# EasyEDA Pro project 嵌入式.eprj, schematic Schematic4
Create Date: 2024-04-12; Page Name: P1; Project Name: 嵌入式; Schematic Name: Schematic4; Update Date: 2024-04-12; Company: 嘉立创EDA; Page Size: A4; Version: V1.0
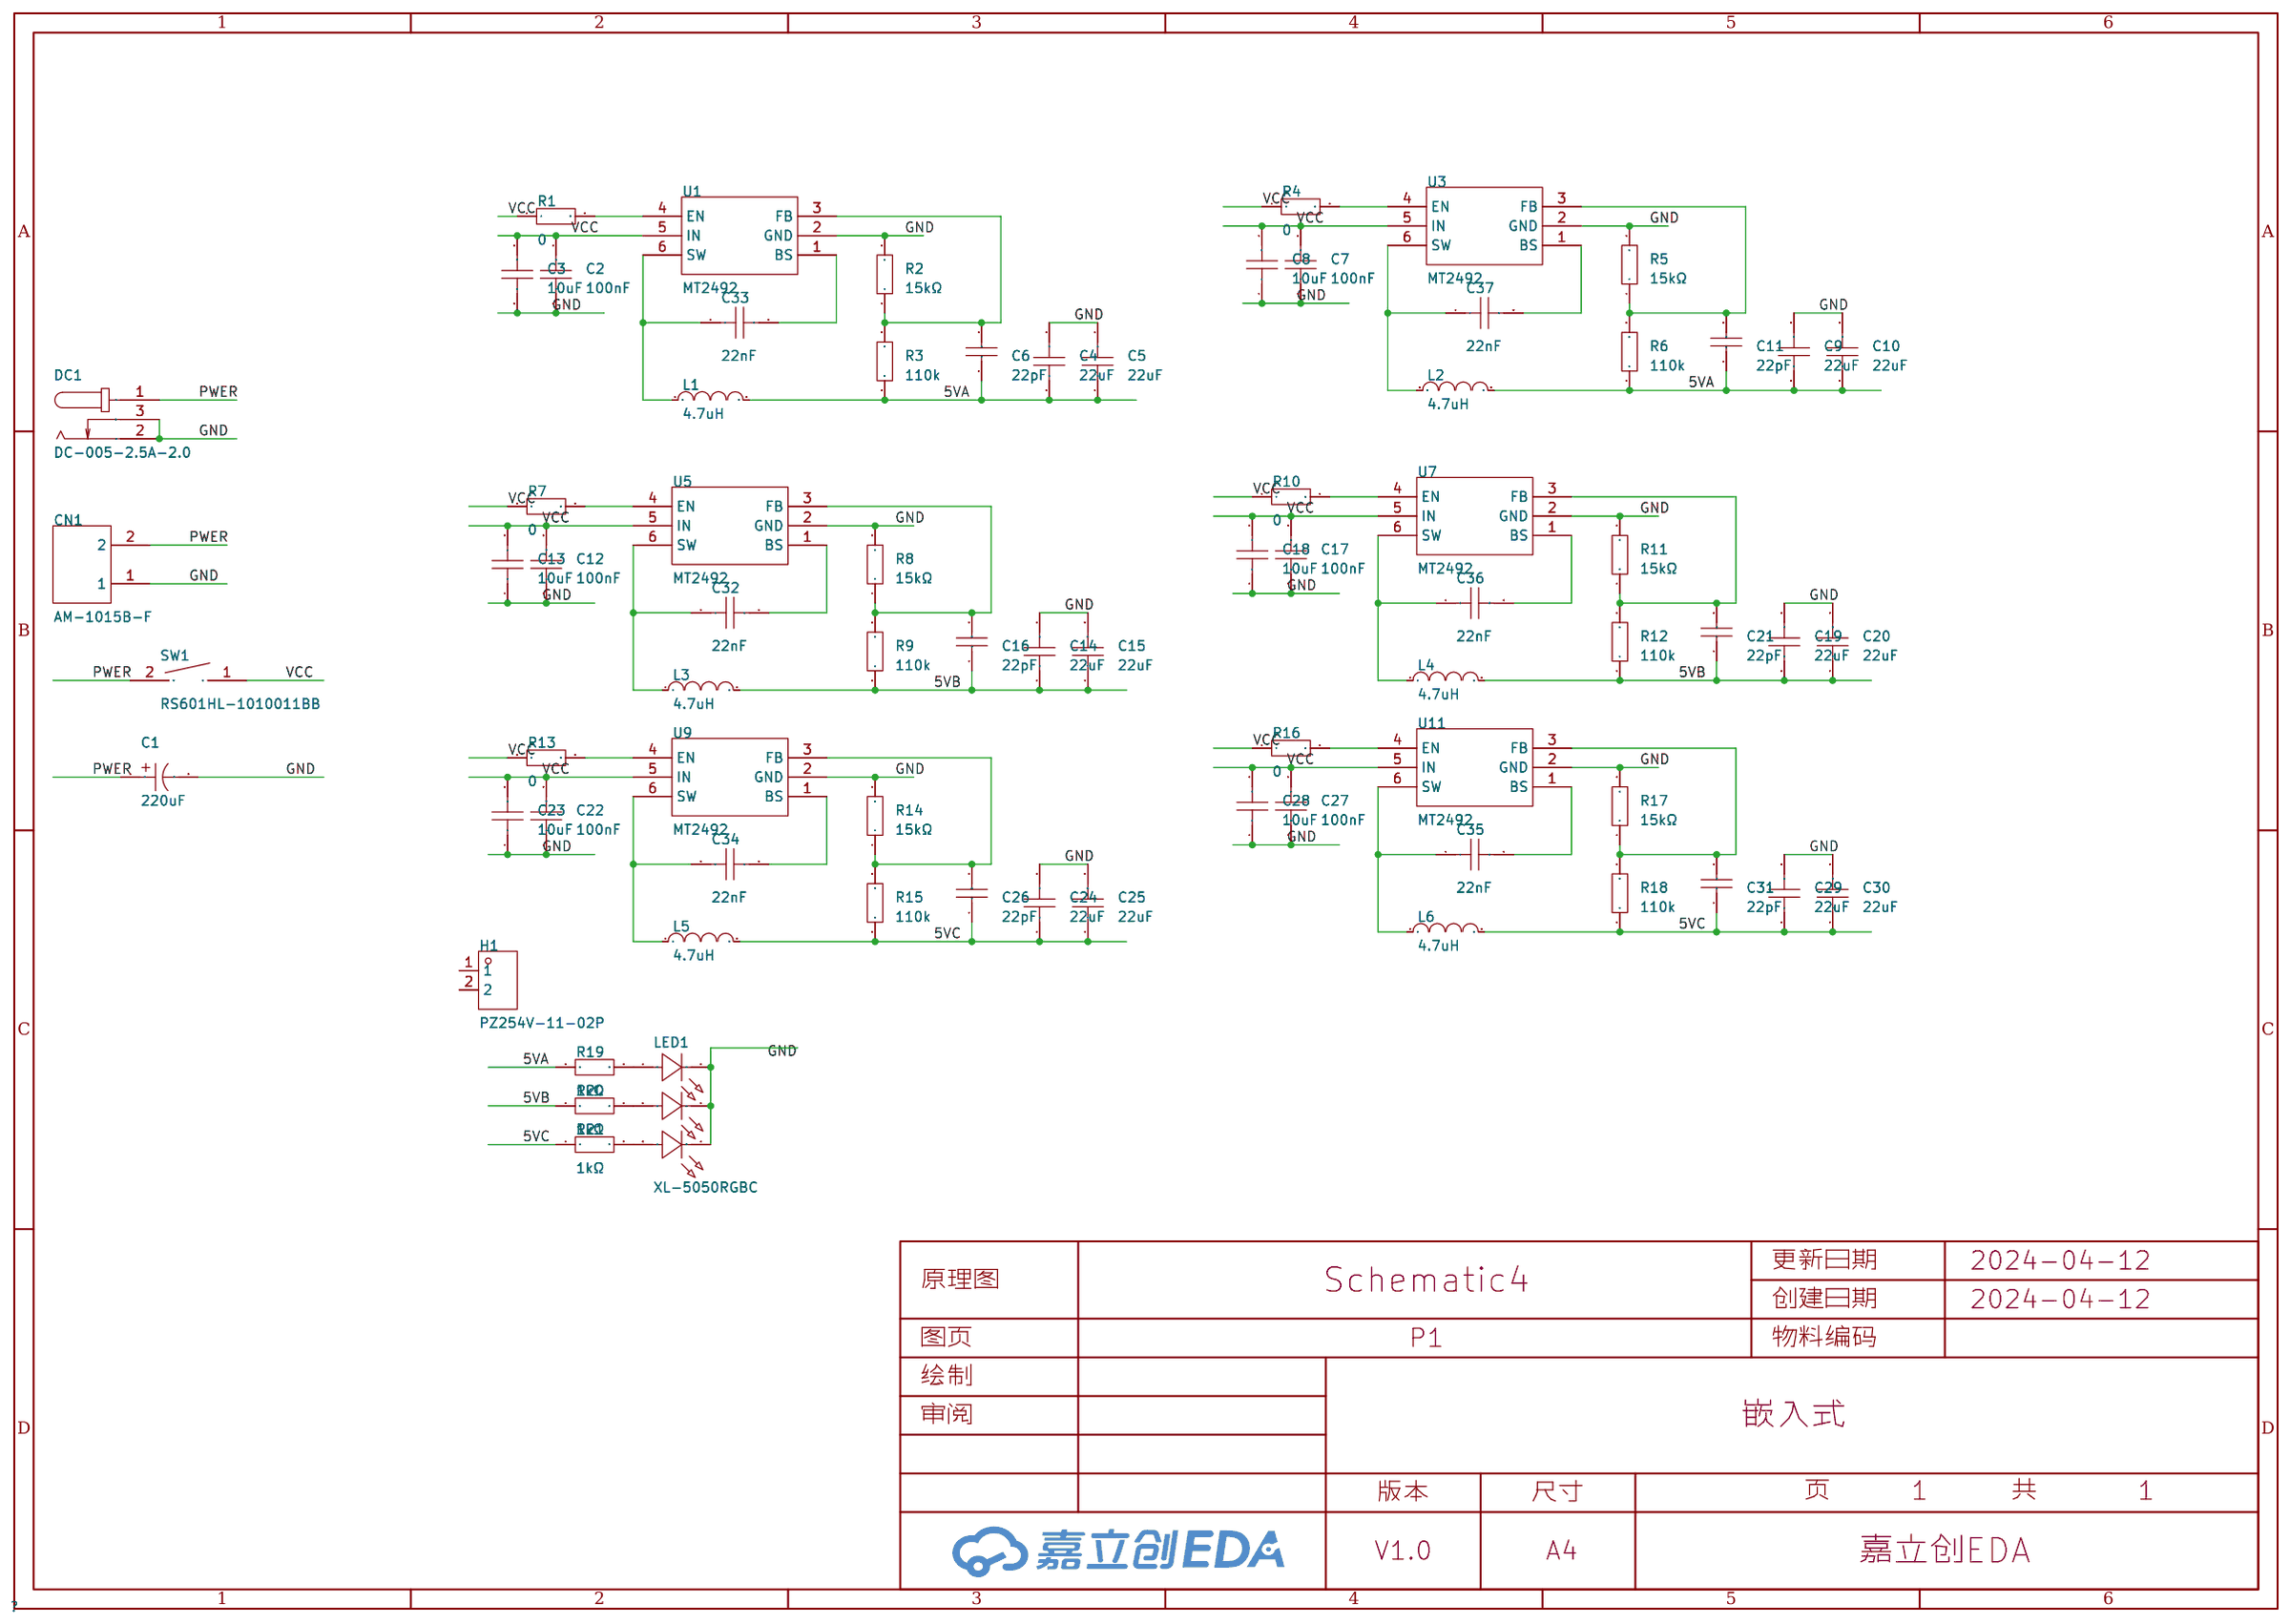
[diagram p3: schematic sheet]

## Parts
C1  220uF  [CAP-SMD_BD6.3-L6.6-W6.6-FD]
C2  100nF  [C0603]
C3  10uF  [C0805]
C4  22uF  [C0805]
C5  22uF  [C0805]
C6  22pF  [C0603]
C7  100nF  [C0603]
C8  10uF  [C0805]
C9  22uF  [C0805]
C10  22uF  [C0805]
C11  22pF  [C0603]
C12  100nF  [C0603]
C13  10uF  [C0805]
C14  22uF  [C0805]
C15  22uF  [C0805]
C16  22pF  [C0603]
C17  100nF  [C0603]
C18  10uF  [C0805]
C19  22uF  [C0805]
C20  22uF  [C0805]
C21  22pF  [C0603]
C22  100nF  [C0603]
C23  10uF  [C0805]
C24  22uF  [C0805]
C25  22uF  [C0805]
C26  22pF  [C0603]
C27  100nF  [C0603]
C28  10uF  [C0805]
C29  22uF  [C0805]
C30  22uF  [C0805]
C31  22pF  [C0603]
C32  22nF  [C0805]
C33  22nF  [C0805]
C34  22nF  [C0805]
C35  22nF  [C0805]
C36  22nF  [C0805]
C37  22nF  [C0805]
CN1  AM-1015B-F  [CONN-TH_AM-1015B-F]
DC1  DC-005-2.5A-2.0  [CONN-TH_DC-005-2.5A-2.0]
H1  PZ254V-11-02P  [HDR-TH_2P-P2.54-V-M]
L1  4.7uH  [IND-SMD_L4.4-W4.2]
L2  4.7uH  [IND-SMD_L4.4-W4.2]
L3  4.7uH  [IND-SMD_L4.4-W4.2]
L4  4.7uH  [IND-SMD_L4.4-W4.2]
L5  4.7uH  [IND-SMD_L4.4-W4.2]
L6  4.7uH  [IND-SMD_L4.4-W4.2]
LED1  XL-5050RGBC  [LED-ARRAY-SMD_6P-L5.0-W5.0-TL-RD_3]
R1  0  [R0805]
R2  15kΩ  [R0805]
R3  110k  [R0805]
R4  0  [R0805]
R5  15kΩ  [R0805]
R6  110k  [R0805]
R7  0  [R0805]
R8  15kΩ  [R0805]
R9  110k  [R0805]
R10  0  [R0805]
R11  15kΩ  [R0805]
R12  110k  [R0805]
R13  0  [R0805]
R14  15kΩ  [R0805]
R15  110k  [R0805]
R16  0  [R0805]
R17  15kΩ  [R0805]
R18  110k  [R0805]
R19  1kΩ  [R0603]
R20  1kΩ  [R0603]
R21  1kΩ  [R0603]
SW1  RS601HL-1010011BB  [SW-TH_RS601HL-1010011BB]
U1  MT2492  [SOT-23-6_L2.9-W1.6-P0.95-LS2.8-BL]
U3  MT2492  [SOT-23-6_L2.9-W1.6-P0.95-LS2.8-BL]
U5  MT2492  [SOT-23-6_L2.9-W1.6-P0.95-LS2.8-BL]
U7  MT2492  [SOT-23-6_L2.9-W1.6-P0.95-LS2.8-BL]
U9  MT2492  [SOT-23-6_L2.9-W1.6-P0.95-LS2.8-BL]
U11  MT2492  [SOT-23-6_L2.9-W1.6-P0.95-LS2.8-BL]

## Library data of the parts
C1 = RVT220UF16V67RV0015: 容值:220uF;精度:±20%;额定电压:16V;纹波电流:110mA@120Hz;等效串联电阻:-;; LCSC Part Name: 220uF ±20% 16V; Supplier Part: C2887273; Manufacturer: KNSCHA(科尼盛); Supplier Footprint: SMD,D6.3xL7.7mm; JLCPCB Part Class: 扩展库; Datasheet: https://atta.szlcsc.com/upload/public/pdf/source/20210824/3DC9999D9B098FE241E3A26137981C4C.pdf; Supplier: LCSC; Tolerance: ±20%; Rated Voltage: 16V; Ripple Current: 110mA@120Hz; φD: 6.3mm; L: 7.7mm; Lifetime @ Temp: 2000hrs@105℃; Operating Temperature: -55℃~+105℃
C2 C7 C12 C17 C22 C27 = CC0603KRX7R9BB104: 容值:100nF;精度:±10%;额定电压:50V;材质(温度系数):X7R;; LCSC Part Name: 100nF ±10% 50V; Supplier Part: C14663; Manufacturer: YAGEO(国巨); Supplier Footprint: 0603; JLCPCB Part Class: 基础库; Datasheet: https://atta.szlcsc.com/upload/public/pdf/source/20180910/C282072_33301C7F631E79921B82A8DAC6BCC5B3.pdf; Supplier: LCSC; Tolerance: ±10%; Voltage Rated: 50V; Temperature Coefficient: X7R
C3 C8 C13 C18 C23 C28 = GRM21BR61H106KE43L: 容值:10uF;精度:±10%;额定电压:50V;材质(温度系数):X5R;; LCSC Part Name: 10uF ±10% 50V; Supplier Part: C440198; Manufacturer: muRata(村田); Supplier Footprint: 0805; JLCPCB Part Class: 基础库; Datasheet: https://atta.szlcsc.com/upload/public/pdf/source/20230811/95AAE0C9AF55EDC31B7A4D8B733F534E.pdf; Supplier: LCSC; Tolerance: ±10%; Voltage Rated: 50V; Temperature Coefficient: X5R
C4 C5 C9 C10 C14 C15 C19 C20 C24 C25 C29 C30 = CL21A226MAQNNNE: 容值:22uF;精度:±20%;额定电压:25V;材质(温度系数):X5R;; LCSC Part Name: 22uF ±20% 25V; Supplier Part: C45783; Manufacturer: SAMSUNG(三星); Supplier Footprint: 0805; JLCPCB Part Class: 基础库; Datasheet: https://atta.szlcsc.com/upload/public/pdf/source/20160218/1457707763339.pdf; Supplier: LCSC; Tolerance: ±20%; Voltage Rated: 25V; Temperature Coefficient: X5R
C6 C11 C16 C21 C26 C31 = CC0603JRNPO9BN220: 容值:22pF;精度:±5%;额定电压:50V;材质(温度系数):NP0;; LCSC Part Name: 22pF ±5% 50V; Supplier Part: C105620; Manufacturer: YAGEO(国巨); Supplier Footprint: 0603; JLCPCB Part Class: 扩展库; Datasheet: https://atta.szlcsc.com/upload/public/pdf/source/20170505/1493957838062.pdf; Supplier: LCSC; Tolerance: ±5%; Voltage Rated: 50V; Temperature Coefficient: NP0
C32-C37 = GRM21B5C1H223JA01L: 容值:22nF;精度:±5%;额定电压:50V;材质(温度系数):C0G;; LCSC Part Name: 22nF ±5% 50V; Supplier Part: C77069; Manufacturer: muRata(村田); Supplier Footprint: 0805; JLCPCB Part Class: 扩展库; Datasheet: https://atta.szlcsc.com/upload/public/pdf/source/20200305/C490387_23319AE8C154DEB24C505E6C82A8106A.pdf; Supplier: LCSC; Tolerance: ±5%; Voltage Rated: 50V; Temperature Coefficient: C0G
CN1 = AM-1015B-F: 类别:-;类型1:-;; LCSC Part Name: AMASS(艾迈斯) 防滑T插T型插头紫红大电流航空连接器AM-1015B-F; Supplier Part: C90630; Manufacturer: AMASS(艾迈斯); JLCPCB Part Class: 扩展库; Datasheet: https://atta.szlcsc.com/upload/public/pdf/source/20161217/1481939174683.pdf; Supplier: LCSC; Brand: 艾迈斯; Type: T行插头; RatedVoltage: DC 500V; InterfaceType: 公母头; MetalMaterial: 铜镀金; InsulationMaterial: PA; RatedCurrent: 25A; RecommendedWireGauge: 12AWG; FlameRetardantGrade: UL94 V0; contact resistance: 0.45mΩ
DC1 = DC-005-2.5A-2.0: 连接器类型:DC电源插座;安装方式:面板安装;触点内径:2mm;触点外径:6.2mm;额定电流:2.5A;额定电压:24V;触头材质:黄铜;工作温度范围:-20℃~+70℃;焊接温度(最大值):260℃;; LCSC Part Name: DC电源插座 内径:2mm 外径:6.2mm; Supplier Part: C319099; Manufacturer: XKB Connectivity(中国星坤); Supplier Footprint: 插件; JLCPCB Part Class: 扩展库; Datasheet: https://atta.szlcsc.com/upload/public/pdf/source/20230410/3C172F25A51FCA230ABE6D36425CBB3B.pdf; Supplier: LCSC; Connector Type: DC电源插座; Mounting Style: 面板安装; Inside Contact Diameter: 2mm; Outside Contact Diameter: 6.2mm; Current Rating (Max): 2.5A; Voltage Rating (Max): 24V; Contact Material: 黄铜; Operating Temperature Range: -20℃~+70℃; Soldering Temperature(Max): 260℃
H1 = PZ254V-11-02P: 插针结构:1x2P;间距:2.54mm;行距:-;圆针/方针:方针;安装类型:直插;排数:单排;总PIN位数:2P;额定电流:-;额定电压:-;配合针长度:6mm;塑高:2.5mm;端接针长度:3mm;触头材质:黄铜;触头镀层:-;工作温度范围:-40℃~+105℃;颜色:黑色;; LCSC Part Name: 间距:2.54mm 1x2P 直插 方针; Supplier Part: C492401; Manufacturer: XFCN(兴飞); Supplier Footprint: 插件,P=2.54mm; JLCPCB Part Class: Extended Part; Datasheet: https://atta.szlcsc.com/upload/public/pdf/source/20200309/C492401_A812433581A9B211A7FFA413ADDFF0E5.pdf; Supplier: LCSC; Pin Structure: 1x2P; Pitch: 2.54mm; Circluar Pins/Square Pins: 方针; Mounting Type: 直插; Number of Rows: 单排; Number of Pins: 2P; Length of Mating Pin: 6mm; Insulation Height: 2.5mm; Length of End Connection Pin: 3mm; Contact Material: 黄铜; Operating Temperature Range: -40℃~+105℃; Color: 黑色
L1-L6 = FXL0420-4R7-M: 电感值:4.7uH;精度:±20%;额定电流:2.8A;饱和电流(Isat):3A;类型:一体成型电感;; LCSC Part Name: 4.7uH ±20% 3A; Supplier Part: C167208; Manufacturer: cjiang(长江微电); Supplier Footprint: SMD,4.2x4.4mm; JLCPCB Part Class: 扩展库; Datasheet: https://atta.szlcsc.com/upload/public/pdf/source/20230516/FBADA9890E7FBE97C620F1D8B562D733.pdf; Supplier: LCSC; Tolerance: ±20%; Rated Current: 2.8A; Saturation Current (Isat): 3A; DC Resistance (DCR): 105mΩ; Type: 一体成型电感
LED1 = XL-5050RGBC: 发光颜色:RGB三色;功率:200mW;正向电流:60mA;主波长:520nm~525nm；620nm~625nm；460nm~470nm;二极管配置:-;透镜颜色:无色透明透镜;发光角度:150°;载带方式:正贴;工作温度:-20℃~+85℃;; Supplier Part: C2843868; Manufacturer: XINGLIGHT(成兴光); Supplier Footprint: SMD5050; JLCPCB Part Class: 扩展库; Datasheet: https://atta.szlcsc.com/upload/public/pdf/source/20221102/73656BFF0F7730F5F4CB2FAFF446686F.pdf; Supplier: LCSC; Emitted Color: RGB三色; Power Dissipation: 200mW; Forward Current: 60mA; Dominant Wavelength: 520nm~525nm；620nm~625nm；460nm~470nm; Peak Wavelength: 525nm；625nm；470nm; Lens Color: 无色透明透镜; Viewing Angle: 150°; Mounting Sytle: 正贴; Operating Temperature: -20℃~+85℃
R1 R4 R7 R10 R13 R16 = 0805W8F1002T5E_C17414: 电阻类型:厚膜电阻;阻值:10kΩ;精度:±1%;功率:125mW;最大工作电压:150V;温度系数:±100ppm/℃;; LCSC Part Name: 10kΩ ±1% 125mW 厚膜电阻; Supplier Part: C17414; Manufacturer: UNI-ROYAL(厚声); Manufacturer Part: 0805W8F1002T5E; Supplier Footprint: 0805; JLCPCB Part Class: 基础库; Datasheet: https://atta.szlcsc.com/upload/public/pdf/source/20200306/C422600_1E6D84923E4A46A82E41ADD87F860B5C.pdf; Supplier: LCSC; Type: 厚膜电阻; Tolerance: ±1%; Power(Watts): 125mW; Overload Voltage (Max): 150V; Temperature Coefficient: ±100ppm/℃; Operating Temperature Range: -55℃~+155℃
R2 R3 R5 R6 R8 R9 R11 R12 R14 R15 R17 R18 = 0805W8F1502T5E: 电阻类型:厚膜电阻;阻值:15kΩ;精度:±1%;功率:125mW;最大工作电压:150V;温度系数:±100ppm/℃;; LCSC Part Name: 15kΩ ±1% 125mW 厚膜电阻; Supplier Part: C17475; Manufacturer: UNI-ROYAL(厚声); Supplier Footprint: 0805; JLCPCB Part Class: 基础库; Datasheet: https://atta.szlcsc.com/upload/public/pdf/source/20200306/C422600_1E6D84923E4A46A82E41ADD87F860B5C.pdf; Supplier: LCSC; Type: 厚膜电阻; Tolerance: ±1%; Power(Watts): 125mW; Overload Voltage (Max): 150V; Temperature Coefficient: ±100ppm/℃; Operating Temperature Range: -55℃~+155℃
R19-R21 = 0603WAF1001T5E: 电阻类型:厚膜电阻;阻值:1kΩ;精度:±1%;功率:100mW;最大工作电压:75V;温度系数:±100ppm/℃;; LCSC Part Name: 1kΩ ±1% 100mW 厚膜电阻; Supplier Part: C21190; Manufacturer: UNI-ROYAL(厚声); Supplier Footprint: 0603; JLCPCB Part Class: 基础库; Datasheet: https://atta.szlcsc.com/upload/public/pdf/source/20200306/C422600_1E6D84923E4A46A82E41ADD87F860B5C.pdf; Supplier: LCSC; Type: 厚膜电阻; Tolerance: ±1%; Power(Watts): 100mW; Overload Voltage (Max): 75V; Temperature Coefficient: ±100ppm/℃; Operating Temperature Range: -55℃~+155℃
SW1 = RS601HL-1010011BB: 带灯:无;引脚样式:焊片;额定电流:3A;额定电压(AC):250V;额定电压(DC):-;电路结构:单刀单掷;机械寿命:1万次;; Supplier Part: C2885782; Manufacturer: HCTL(华灿天禄); Supplier Footprint: 插件; JLCPCB Part Class: 扩展库; Datasheet: https://atta.szlcsc.com/upload/public/pdf/source/20210820/B1970E40D09304D7FA648AE2099FB3E8.pdf; Supplier: LCSC; Switch Length: 15mm; Switch Width: 10.5mm; Switch Height: 11.7mm; Actuator Type: 凹面弯曲; With Lamp: 无; Pin Style: 焊片; Actuator Color: 黑色; Contact Current: 3A; Voltage Rating (AC): 250V; Circuit: 单刀单掷; Mechanical Life: 1万次; Operating Temperature: -25℃~+85℃; Actuator Identifier: - O
U1 U3 U5 U7 U9 U11 = MT2492: 功能类型:降压型;输入电压:-;输出电流(最大值):-;; Supplier Part: C89358; Manufacturer: 西安航天民芯; Supplier Footprint: SOT-23-6; JLCPCB Part Class: 扩展库; Datasheet: https://atta.szlcsc.com/upload/public/pdf/source/20221209/5C81DA9662873D3A116170FFBF63E49D.pdf; Supplier: LCSC; Function: 降压型; Switch tube (built-in/external): 内置

## Nets
5VA: C4.1 C5.1 C6.1 C9.1 C10.1 C11.1 L1.2 L2.2 R3.1 R6.1 R19.1
5VB: C14.1 C15.1 C16.1 C19.1 C20.1 C21.1 L3.2 L4.2 R9.1 R12.1 R20.1
5VC: C24.1 C25.1 C26.1 C29.1 C30.1 C31.1 L5.2 L6.2 R15.1 R18.1 R21.1
GND: C1.2 C2.1 C3.1 C4.2 C5.2 C7.1 C8.1 C9.2 C10.2 C12.1 C13.1 C14.2 C15.2 C17.1 C18.1 C19.2 C20.2 C22.1 C23.1 C24.2 C25.2 C27.1 C28.1 C29.2 C30.2 CN1.1 DC1.2 DC1.3 LED1.1(B-) LED1.2(R-) LED1.3(G-) R2.2 R5.2 R8.2 R11.2 R14.2 R17.2 U1.2(GND) U3.2(GND) U5.2(GND) U7.2(GND) U9.2(GND) U11.2(GND)
VCC: C2.2 C3.2 C7.2 C8.2 C12.2 C13.2 C17.2 C18.2 C22.2 C23.2 C27.2 C28.2 R1.1 R4.1 R7.1 R10.1 R13.1 R16.1 SW1.1 U1.5(IN) U3.5(IN) U5.5(IN) U7.5(IN) U9.5(IN) U11.5(IN)
PWER: C1.1 CN1.2 DC1.1 SW1.2
$1N570: R1.2 U1.4(EN)
$1N904: C33.1 L1.1 U1.6(SW)
$1N917: C33.2 U1.1(BS)
$1N1064: C6.2 R2.1 R3.2 U1.3(FB)
$1N4201: LED1.5(R+) R20.2
$1N4240: LED1.6(B+) R21.2
$1N4279: LED1.4(G+) R19.2
Net-(C11-2): C11.2 R5.1 R6.2 U3.3(FB)
Net-(C16-2): C16.2 R8.1 R9.2 U5.3(FB)
Net-(C21-2): C21.2 R11.1 R12.2 U7.3(FB)
Net-(C26-2): C26.2 R14.1 R15.2 U9.3(FB)
Net-(C31-2): C31.2 R17.1 R18.2 U11.3(FB)
Net-(C32-1): C32.1 L3.1 U5.6(SW)
Net-(C32-2): C32.2 U5.1(BS)
Net-(C34-1): C34.1 L5.1 U9.6(SW)
Net-(C34-2): C34.2 U9.1(BS)
Net-(C35-1): C35.1 L6.1 U11.6(SW)
Net-(C35-2): C35.2 U11.1(BS)
Net-(C36-1): C36.1 L4.1 U7.6(SW)
Net-(C36-2): C36.2 U7.1(BS)
Net-(C37-1): C37.1 L2.1 U3.6(SW)
Net-(C37-2): C37.2 U3.1(BS)
Net-(R4-2): R4.2 U3.4(EN)
Net-(R7-2): R7.2 U5.4(EN)
Net-(R10-2): R10.2 U7.4(EN)
Net-(R13-2): R13.2 U9.4(EN)
Net-(R16-2): R16.2 U11.4(EN)

Not connected (* = marked no-connect by the designer): H1 1 2
